# EasyEDA Pro project kuafu01_030内部老化方案.eprj, board PCB4
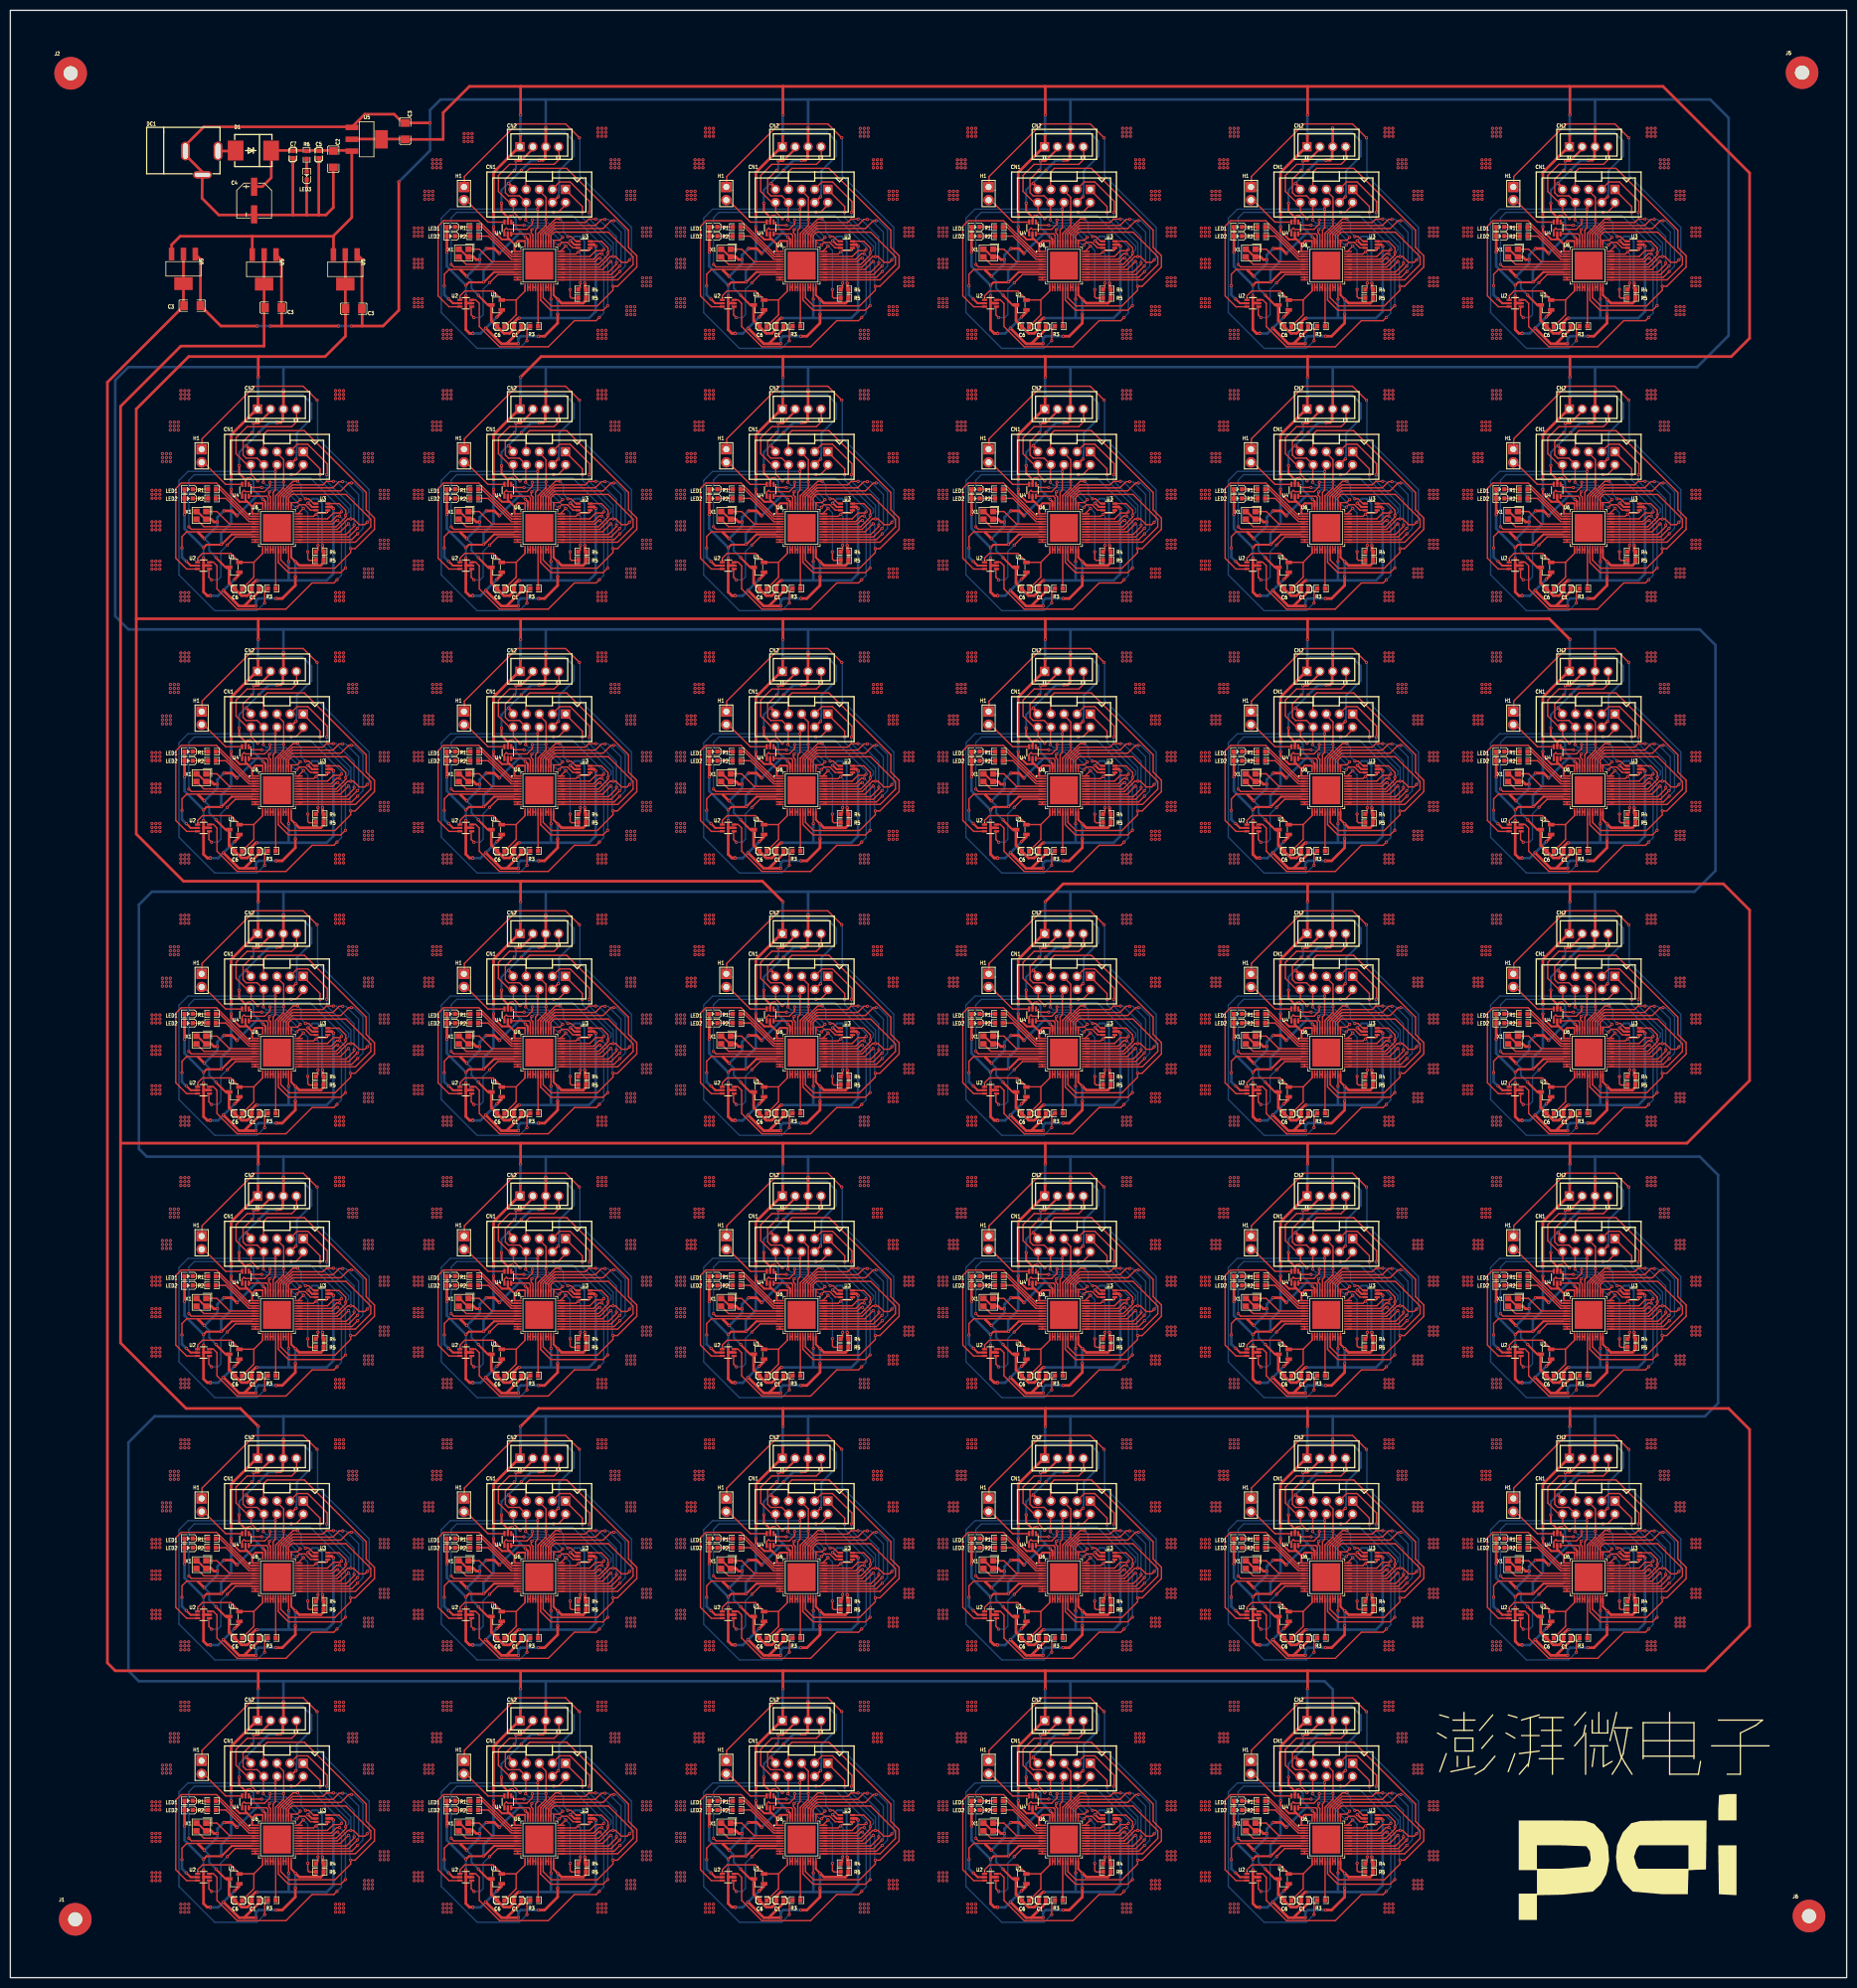
[diagram p2: board, top side]
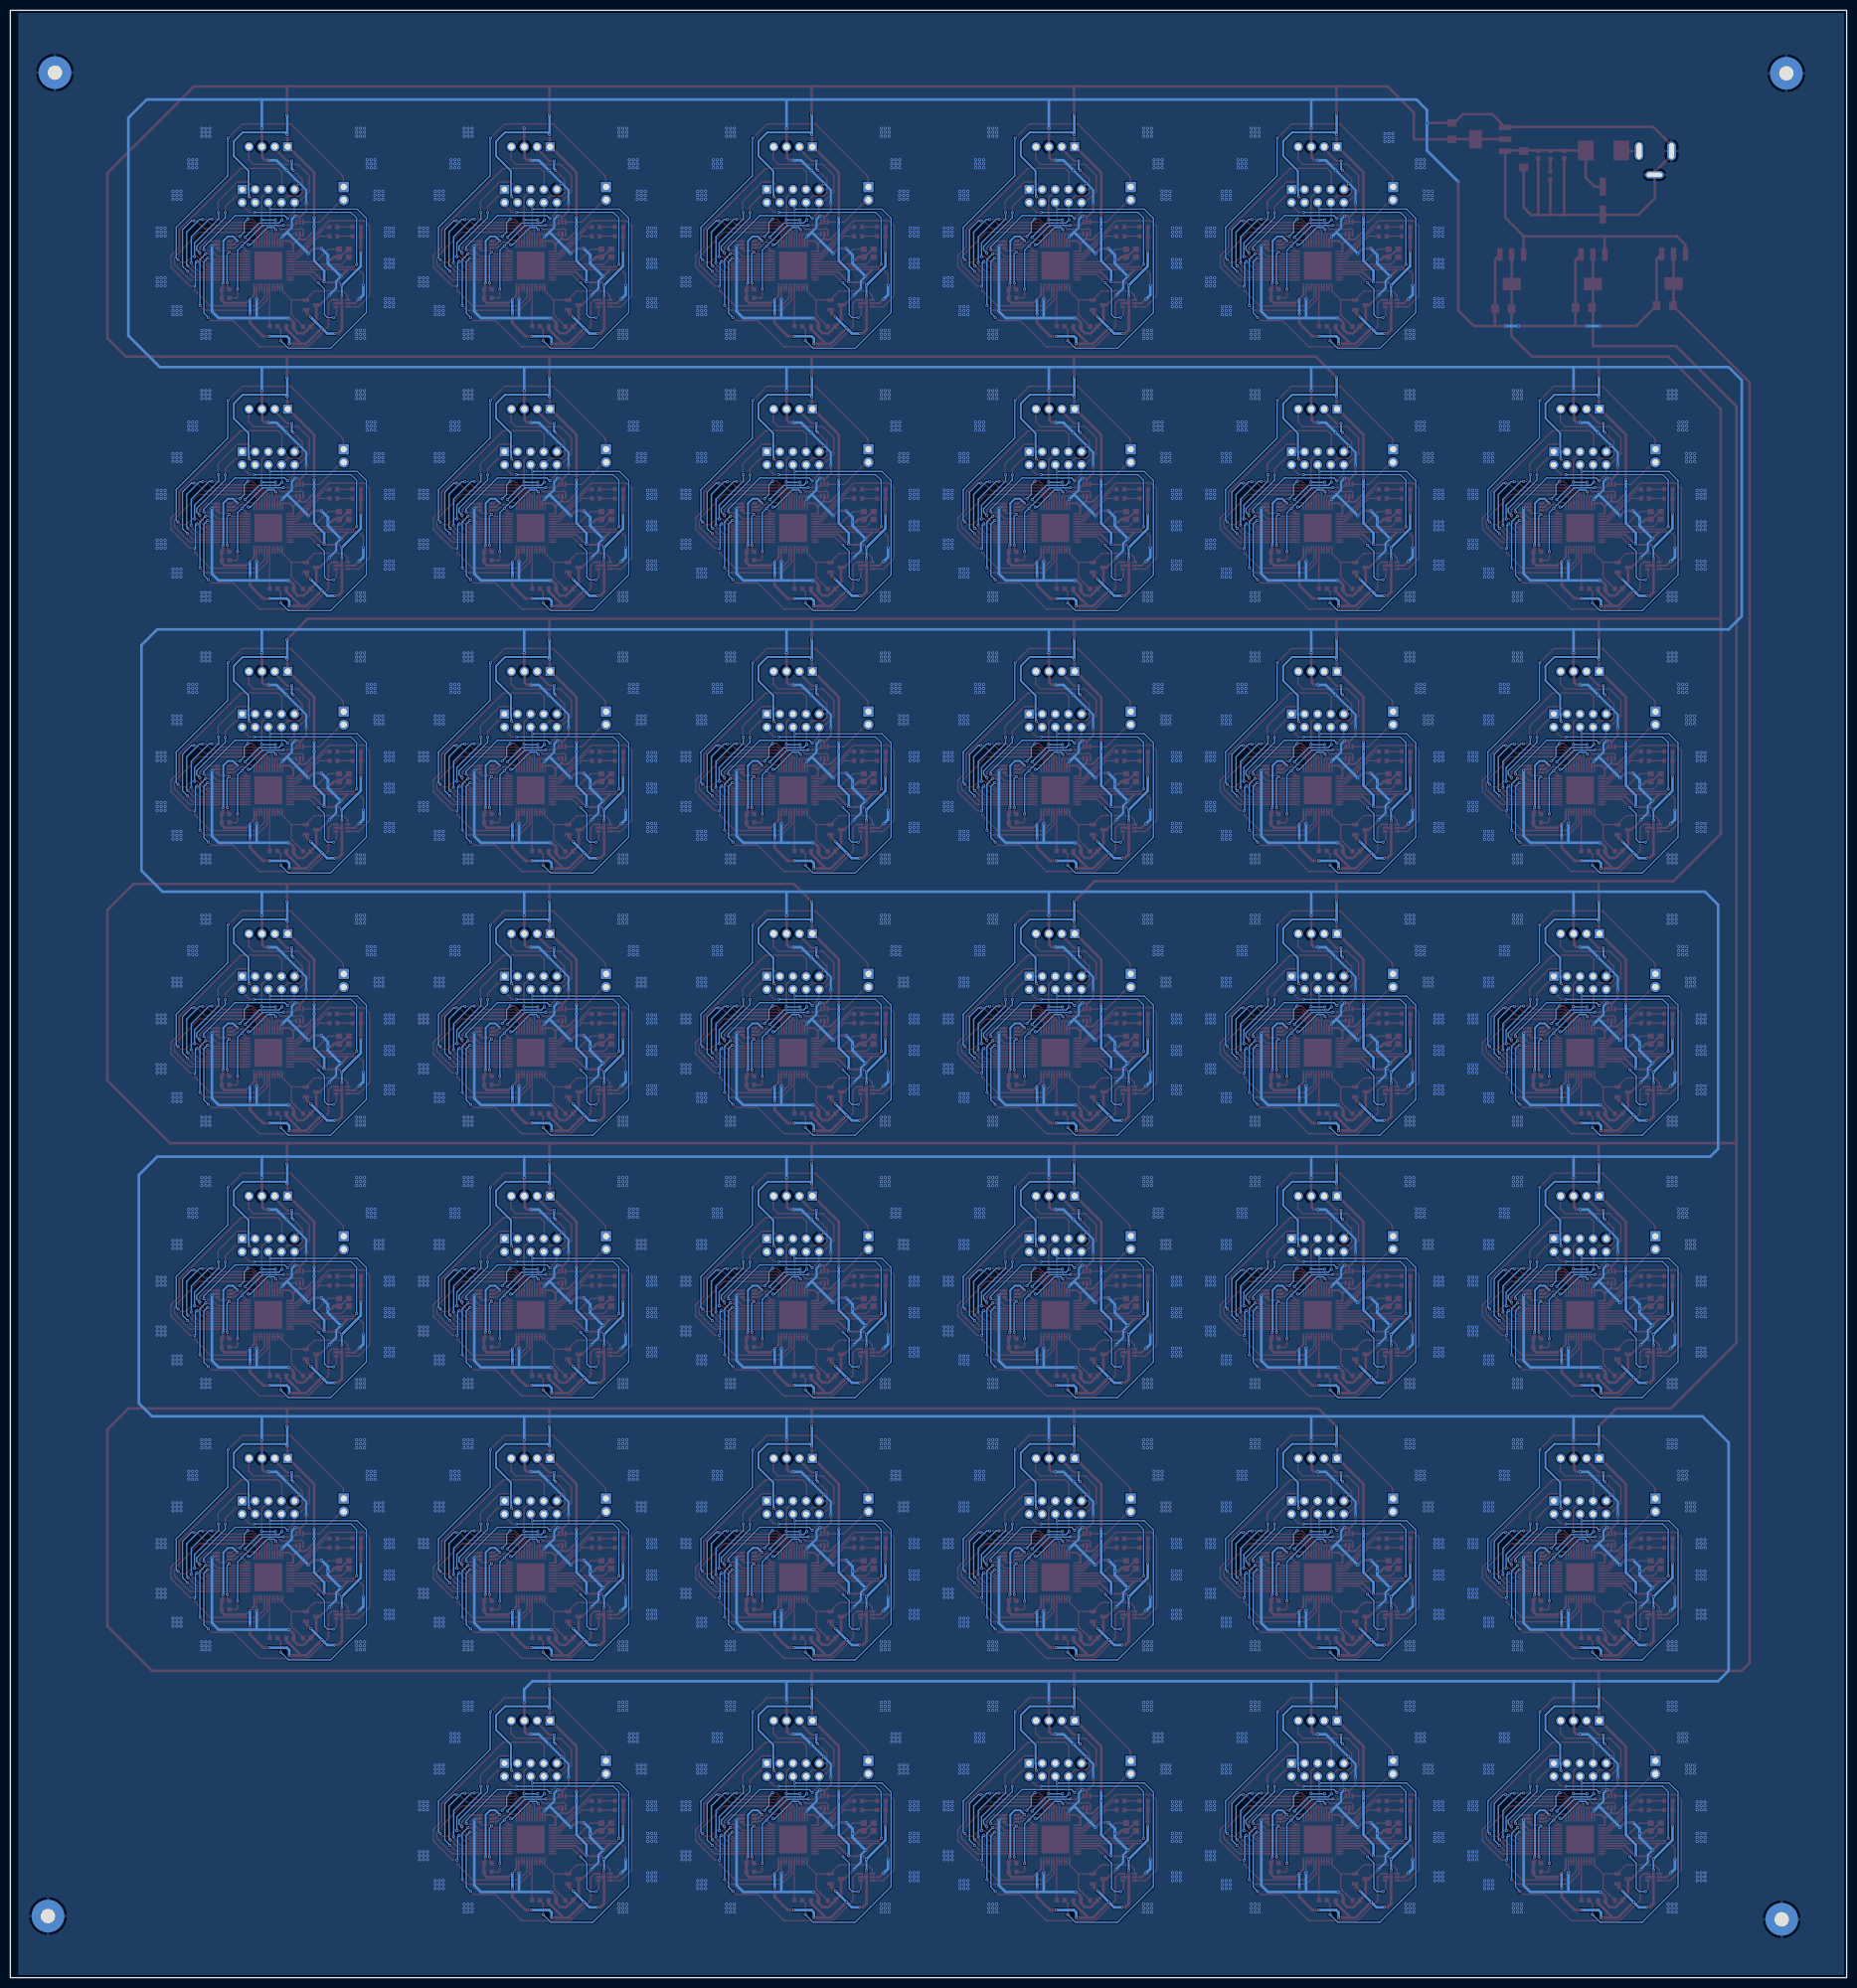
[diagram p3: board, bottom side, seen from below]

Outline 355.6 x 381 mm; copper layers: Top Layer, Bottom Layer. Coordinates in mm from the lower left corner of the outline.
Outline path: rectangle 0,381 355.6,0
Stack: Top Layer 0.035mm / Dielectric1 1.51mm FR4 er 4.5 / Bottom Layer 0.035mm

## Design rules (mm)
spacing safeClearance (default): track to track 0.152, other pairs 0.152 to 0.3
track width trackWidth (default): min 0.127, default 0.254, max 2.54
differential pair differentialPair (default): width min 0.127, default 0.254, max 2.54; gap min 0.152, default 0.152
via viaSize (default): diameter min 0.5, default 0.61, max 10; hole min 0.3, default 0.305, max 6

## Placement (name value [footprint] x y rotation side)
C1  470nF  [C0603]  301.44 268.96 180 top
C1#2  -  [C0603]  47.44 218.16 180 top
C1#3  -  [C0603]  98.24 218.16 180 top
C1#4  -  [C0603]  149.04 218.16 180 top
C1#5  -  [C0603]  199.84 218.16 180 top
C1#6  -  [C0603]  250.64 218.16 180 top
C1#7  -  [C0603]  301.44 218.16 180 top
C1#8  -  [C0603]  47.44 167.37 180 top
C1#9  -  [C0603]  98.24 167.37 180 top
C1#10  -  [C0603]  149.04 167.37 180 top
C1#11  -  [C0603]  199.84 167.37 180 top
C1#12  -  [C0603]  250.64 167.37 180 top
C1#13  -  [C0603]  301.44 167.37 180 top
C1#14  -  [C0603]  47.44 116.56 180 top
C1#15  -  [C0603]  98.24 116.56 180 top
C1#16  -  [C0603]  149.04 116.56 180 top
C1#17  -  [C0603]  199.84 116.56 180 top
C1#18  -  [C0603]  250.64 116.56 180 top
C1#19  -  [C0603]  301.44 116.56 180 top
C1#20  -  [C0603]  47.44 65.76 180 top
C1#21  -  [C0603]  98.24 65.76 180 top
C1#22  -  [C0603]  149.04 65.76 180 top
C1#23  -  [C0603]  199.84 65.76 180 top
C1#24  -  [C0603]  250.64 65.76 180 top
C1#25  -  [C0603]  301.44 65.76 180 top
C1#26  -  [C0603]  47.44 14.96 180 top
C1#27  -  [C0603]  98.24 14.96 180 top
C1#28  -  [C0603]  149.04 14.96 180 top
C1#29  -  [C0603]  199.84 14.96 180 top
C1#30  -  [C0603]  250.64 14.96 180 top
C1#31  -  [C0603]  98.24 319.76 180 top
C1#32  -  [C0603]  149.04 319.76 180 top
C1#33  -  [C0603]  199.84 319.76 180 top
C1#34  -  [C0603]  250.64 319.76 180 top
C1#35  -  [C0603]  301.44 319.76 180 top
C1#36  -  [C0603]  47.44 268.96 180 top
C1#37  -  [C0603]  98.24 268.96 180 top
C1#38  -  [C0603]  149.04 268.96 180 top
C1#39  -  [C0603]  199.84 268.96 180 top
C1#40  -  [C0603]  250.64 268.96 180 top
C2  10uF  [C1206]  62.54 352.17 270 top
C3  10uF  [C1206]  35.23 323.81 180 top
C3#2  -  [C1206]  50.91 323.42 180 top
C3#3  -  [C1206]  76.47 357.6 270 top
C3#4  -  [C1206]  66.49 323.21 180 top
C4  100uF  [CAP-SMD_BD6.3-L6.6-W6.6-LS7.6-FD-1]  47.21 344.16 270 top
C5  100nF  [C0603]  59.73 353.07 90 top
C6  100nF  [C0603]  298.19 268.95 0 top
C6#2  -  [C0603]  44.19 218.15 0 top
C6#3  -  [C0603]  94.99 218.15 0 top
C6#4  -  [C0603]  145.79 218.15 0 top
C6#5  -  [C0603]  196.59 218.15 0 top
C6#6  -  [C0603]  247.39 218.15 0 top
C6#7  -  [C0603]  298.19 218.15 0 top
C6#8  -  [C0603]  44.19 167.35 0 top
C6#9  -  [C0603]  94.99 167.35 0 top
C6#10  -  [C0603]  145.79 167.35 0 top
C6#11  -  [C0603]  196.59 167.35 0 top
C6#12  -  [C0603]  247.39 167.35 0 top
C6#13  -  [C0603]  298.19 167.35 0 top
C6#14  -  [C0603]  44.19 116.55 0 top
C6#15  -  [C0603]  94.99 116.55 0 top
C6#16  -  [C0603]  145.79 116.55 0 top
C6#17  -  [C0603]  196.59 116.55 0 top
C6#18  -  [C0603]  247.39 116.55 0 top
C6#19  -  [C0603]  298.19 116.55 0 top
C6#20  -  [C0603]  44.19 65.75 0 top
C6#21  -  [C0603]  94.99 65.75 0 top
C6#22  -  [C0603]  145.79 65.75 0 top
C6#23  -  [C0603]  196.59 65.75 0 top
C6#24  -  [C0603]  247.39 65.75 0 top
C6#25  -  [C0603]  298.19 65.75 0 top
C6#26  -  [C0603]  44.19 14.95 0 top
C6#27  -  [C0603]  94.99 14.95 0 top
C6#28  -  [C0603]  145.79 14.95 0 top
C6#29  -  [C0603]  196.59 14.95 0 top
C6#30  -  [C0603]  247.39 14.95 0 top
C6#31  -  [C0603]  94.99 319.75 0 top
C6#32  -  [C0603]  145.79 319.75 0 top
C6#33  -  [C0603]  196.59 319.75 0 top
C6#34  -  [C0603]  247.39 319.75 0 top
C6#35  -  [C0603]  298.19 319.75 0 top
C6#36  -  [C0603]  44.19 268.95 0 top
C6#37  -  [C0603]  94.99 268.95 0 top
C6#38  -  [C0603]  145.79 268.95 0 top
C6#39  -  [C0603]  196.59 268.95 0 top
C6#40  -  [C0603]  247.39 268.95 0 top
C7  100nF  [C0603]  54.7 353.09 90 top
CN1  DS254P-2X5-L0  [IDC-TH_10P-P2.54-V-R2-C5-S2.54]  305.64 294.25 180 top
CN1#2  -  [IDC-TH_10P-P2.54-V-R2-C5-S2.54]  51.64 243.45 180 top
CN1#3  -  [IDC-TH_10P-P2.54-V-R2-C5-S2.54]  102.44 243.45 180 top
CN1#4  -  [IDC-TH_10P-P2.54-V-R2-C5-S2.54]  153.24 243.45 180 top
CN1#5  -  [IDC-TH_10P-P2.54-V-R2-C5-S2.54]  204.04 243.45 180 top
CN1#6  -  [IDC-TH_10P-P2.54-V-R2-C5-S2.54]  254.84 243.45 180 top
CN1#7  -  [IDC-TH_10P-P2.54-V-R2-C5-S2.54]  305.64 243.45 180 top
CN1#8  -  [IDC-TH_10P-P2.54-V-R2-C5-S2.54]  51.64 192.65 180 top
CN1#9  -  [IDC-TH_10P-P2.54-V-R2-C5-S2.54]  102.44 192.65 180 top
CN1#10  -  [IDC-TH_10P-P2.54-V-R2-C5-S2.54]  153.24 192.65 180 top
CN1#11  -  [IDC-TH_10P-P2.54-V-R2-C5-S2.54]  204.04 192.65 180 top
CN1#12  -  [IDC-TH_10P-P2.54-V-R2-C5-S2.54]  254.84 192.65 180 top
CN1#13  -  [IDC-TH_10P-P2.54-V-R2-C5-S2.54]  305.64 192.65 180 top
CN1#14  -  [IDC-TH_10P-P2.54-V-R2-C5-S2.54]  51.64 141.85 180 top
CN1#15  -  [IDC-TH_10P-P2.54-V-R2-C5-S2.54]  102.44 141.85 180 top
CN1#16  -  [IDC-TH_10P-P2.54-V-R2-C5-S2.54]  153.24 141.85 180 top
CN1#17  -  [IDC-TH_10P-P2.54-V-R2-C5-S2.54]  204.04 141.85 180 top
CN1#18  -  [IDC-TH_10P-P2.54-V-R2-C5-S2.54]  254.84 141.85 180 top
CN1#19  -  [IDC-TH_10P-P2.54-V-R2-C5-S2.54]  305.64 141.85 180 top
CN1#20  -  [IDC-TH_10P-P2.54-V-R2-C5-S2.54]  51.64 91.05 180 top
CN1#21  -  [IDC-TH_10P-P2.54-V-R2-C5-S2.54]  102.44 91.05 180 top
CN1#22  -  [IDC-TH_10P-P2.54-V-R2-C5-S2.54]  153.24 91.05 180 top
CN1#23  -  [IDC-TH_10P-P2.54-V-R2-C5-S2.54]  204.04 91.05 180 top
CN1#24  -  [IDC-TH_10P-P2.54-V-R2-C5-S2.54]  254.84 91.05 180 top
CN1#25  -  [IDC-TH_10P-P2.54-V-R2-C5-S2.54]  305.64 91.05 180 top
CN1#26  -  [IDC-TH_10P-P2.54-V-R2-C5-S2.54]  51.64 40.25 180 top
CN1#27  -  [IDC-TH_10P-P2.54-V-R2-C5-S2.54]  102.44 40.25 180 top
CN1#28  -  [IDC-TH_10P-P2.54-V-R2-C5-S2.54]  153.24 40.25 180 top
CN1#29  -  [IDC-TH_10P-P2.54-V-R2-C5-S2.54]  204.04 40.25 180 top
CN1#30  -  [IDC-TH_10P-P2.54-V-R2-C5-S2.54]  254.84 40.25 180 top
CN1#31  -  [IDC-TH_10P-P2.54-V-R2-C5-S2.54]  102.44 345.05 180 top
CN1#32  -  [IDC-TH_10P-P2.54-V-R2-C5-S2.54]  153.24 345.05 180 top
CN1#33  -  [IDC-TH_10P-P2.54-V-R2-C5-S2.54]  204.04 345.05 180 top
CN1#34  -  [IDC-TH_10P-P2.54-V-R2-C5-S2.54]  254.84 345.05 180 top
CN1#35  -  [IDC-TH_10P-P2.54-V-R2-C5-S2.54]  305.64 345.05 180 top
CN1#36  -  [IDC-TH_10P-P2.54-V-R2-C5-S2.54]  51.64 294.25 180 top
CN1#37  -  [IDC-TH_10P-P2.54-V-R2-C5-S2.54]  102.44 294.25 180 top
CN1#38  -  [IDC-TH_10P-P2.54-V-R2-C5-S2.54]  153.24 294.25 180 top
CN1#39  -  [IDC-TH_10P-P2.54-V-R2-C5-S2.54]  204.04 294.25 180 top
CN1#40  -  [IDC-TH_10P-P2.54-V-R2-C5-S2.54]  254.84 294.25 180 top
CN2  XH-4A  [CONN-TH_4P-P2.50_XH-4A]  305.63 303.77 0 top
CN2#2  -  [CONN-TH_4P-P2.50_XH-4A]  51.63 252.97 0 top
CN2#3  -  [CONN-TH_4P-P2.50_XH-4A]  102.43 252.97 0 top
CN2#4  -  [CONN-TH_4P-P2.50_XH-4A]  153.23 252.97 0 top
CN2#5  -  [CONN-TH_4P-P2.50_XH-4A]  204.03 252.97 0 top
CN2#6  -  [CONN-TH_4P-P2.50_XH-4A]  254.83 252.97 0 top
CN2#7  -  [CONN-TH_4P-P2.50_XH-4A]  305.63 252.97 0 top
CN2#8  -  [CONN-TH_4P-P2.50_XH-4A]  51.63 202.17 0 top
CN2#9  -  [CONN-TH_4P-P2.50_XH-4A]  102.43 202.17 0 top
CN2#10  -  [CONN-TH_4P-P2.50_XH-4A]  153.23 202.17 0 top
CN2#11  -  [CONN-TH_4P-P2.50_XH-4A]  204.03 202.17 0 top
CN2#12  -  [CONN-TH_4P-P2.50_XH-4A]  254.83 202.17 0 top
CN2#13  -  [CONN-TH_4P-P2.50_XH-4A]  305.63 202.17 0 top
CN2#14  -  [CONN-TH_4P-P2.50_XH-4A]  51.63 151.37 0 top
CN2#15  -  [CONN-TH_4P-P2.50_XH-4A]  102.43 151.37 0 top
CN2#16  -  [CONN-TH_4P-P2.50_XH-4A]  153.23 151.37 0 top
CN2#17  -  [CONN-TH_4P-P2.50_XH-4A]  204.03 151.37 0 top
CN2#18  -  [CONN-TH_4P-P2.50_XH-4A]  254.83 151.37 0 top
CN2#19  -  [CONN-TH_4P-P2.50_XH-4A]  305.63 151.37 0 top
CN2#20  -  [CONN-TH_4P-P2.50_XH-4A]  51.63 100.57 0 top
CN2#21  -  [CONN-TH_4P-P2.50_XH-4A]  102.43 100.57 0 top
CN2#22  -  [CONN-TH_4P-P2.50_XH-4A]  153.23 100.57 0 top
CN2#23  -  [CONN-TH_4P-P2.50_XH-4A]  204.03 100.57 0 top
CN2#24  -  [CONN-TH_4P-P2.50_XH-4A]  254.83 100.57 0 top
CN2#25  -  [CONN-TH_4P-P2.50_XH-4A]  305.63 100.57 0 top
CN2#26  -  [CONN-TH_4P-P2.50_XH-4A]  51.63 49.77 0 top
CN2#27  -  [CONN-TH_4P-P2.50_XH-4A]  102.43 49.77 0 top
CN2#28  -  [CONN-TH_4P-P2.50_XH-4A]  153.23 49.77 0 top
CN2#29  -  [CONN-TH_4P-P2.50_XH-4A]  204.03 49.77 0 top
CN2#30  -  [CONN-TH_4P-P2.50_XH-4A]  254.83 49.77 0 top
CN2#31  -  [CONN-TH_4P-P2.50_XH-4A]  102.43 354.57 0 top
CN2#32  -  [CONN-TH_4P-P2.50_XH-4A]  153.23 354.57 0 top
CN2#33  -  [CONN-TH_4P-P2.50_XH-4A]  204.03 354.57 0 top
CN2#34  -  [CONN-TH_4P-P2.50_XH-4A]  254.83 354.57 0 top
CN2#35  -  [CONN-TH_4P-P2.50_XH-4A]  305.63 354.57 0 top
CN2#36  -  [CONN-TH_4P-P2.50_XH-4A]  51.63 303.77 0 top
CN2#37  -  [CONN-TH_4P-P2.50_XH-4A]  102.43 303.77 0 top
CN2#38  -  [CONN-TH_4P-P2.50_XH-4A]  153.23 303.77 0 top
CN2#39  -  [CONN-TH_4P-P2.50_XH-4A]  204.03 303.77 0 top
CN2#40  -  [CONN-TH_4P-P2.50_XH-4A]  254.83 303.77 0 top
D1  SS36-E3/57T  [SMC_L7.1-W6.2-LS8.1-R-RD]  47.06 353.84 180 top
DC1  HX DC005 QT  [DC-IN-TH_HANXIA_HX-DC005-QT]  37.05 351.45 0 top
H1  PZ254V-11-02P  [HDR-TH_2P-P2.54-V-M]  291.04 294.73 270 top
H1#2  -  [HDR-TH_2P-P2.54-V-M]  37.04 243.93 270 top
H1#3  -  [HDR-TH_2P-P2.54-V-M]  87.84 243.93 270 top
H1#4  -  [HDR-TH_2P-P2.54-V-M]  138.64 243.93 270 top
H1#5  -  [HDR-TH_2P-P2.54-V-M]  189.44 243.93 270 top
H1#6  -  [HDR-TH_2P-P2.54-V-M]  240.24 243.93 270 top
H1#7  -  [HDR-TH_2P-P2.54-V-M]  291.04 243.93 270 top
H1#8  -  [HDR-TH_2P-P2.54-V-M]  37.04 193.13 270 top
H1#9  -  [HDR-TH_2P-P2.54-V-M]  87.84 193.13 270 top
H1#10  -  [HDR-TH_2P-P2.54-V-M]  138.64 193.13 270 top
H1#11  -  [HDR-TH_2P-P2.54-V-M]  189.44 193.13 270 top
H1#12  -  [HDR-TH_2P-P2.54-V-M]  240.24 193.13 270 top
H1#13  -  [HDR-TH_2P-P2.54-V-M]  291.04 193.13 270 top
H1#14  -  [HDR-TH_2P-P2.54-V-M]  37.04 142.33 270 top
H1#15  -  [HDR-TH_2P-P2.54-V-M]  87.84 142.33 270 top
H1#16  -  [HDR-TH_2P-P2.54-V-M]  138.64 142.33 270 top
H1#17  -  [HDR-TH_2P-P2.54-V-M]  189.44 142.33 270 top
H1#18  -  [HDR-TH_2P-P2.54-V-M]  240.24 142.33 270 top
H1#19  -  [HDR-TH_2P-P2.54-V-M]  291.04 142.33 270 top
H1#20  -  [HDR-TH_2P-P2.54-V-M]  37.04 91.53 270 top
H1#21  -  [HDR-TH_2P-P2.54-V-M]  87.84 91.53 270 top
H1#22  -  [HDR-TH_2P-P2.54-V-M]  138.64 91.53 270 top
H1#23  -  [HDR-TH_2P-P2.54-V-M]  189.44 91.53 270 top
H1#24  -  [HDR-TH_2P-P2.54-V-M]  240.24 91.53 270 top
H1#25  -  [HDR-TH_2P-P2.54-V-M]  291.04 91.53 270 top
H1#26  -  [HDR-TH_2P-P2.54-V-M]  37.04 40.73 270 top
H1#27  -  [HDR-TH_2P-P2.54-V-M]  87.84 40.73 270 top
H1#28  -  [HDR-TH_2P-P2.54-V-M]  138.64 40.73 270 top
H1#29  -  [HDR-TH_2P-P2.54-V-M]  189.44 40.73 270 top
H1#30  -  [HDR-TH_2P-P2.54-V-M]  240.24 40.73 270 top
H1#31  -  [HDR-TH_2P-P2.54-V-M]  87.84 345.53 270 top
H1#32  -  [HDR-TH_2P-P2.54-V-M]  138.64 345.53 270 top
H1#33  -  [HDR-TH_2P-P2.54-V-M]  189.44 345.53 270 top
H1#34  -  [HDR-TH_2P-P2.54-V-M]  240.24 345.53 270 top
H1#35  -  [HDR-TH_2P-P2.54-V-M]  291.04 345.53 270 top
H1#36  -  [HDR-TH_2P-P2.54-V-M]  37.04 294.73 270 top
H1#37  -  [HDR-TH_2P-P2.54-V-M]  87.84 294.73 270 top
H1#38  -  [HDR-TH_2P-P2.54-V-M]  138.64 294.73 270 top
H1#39  -  [HDR-TH_2P-P2.54-V-M]  189.44 294.73 270 top
H1#40  -  [HDR-TH_2P-P2.54-V-M]  240.24 294.73 270 top
J1  -  [DEMO板安装孔]  12.57 11.3 0 top
J2  -  [DEMO板安装孔]  11.68 368.81 0 top
J5  -  [DEMO板安装孔]  346.96 368.94 0 top
J6  -  [DEMO板安装孔]  348.31 11.93 0 top
LED1  NCD0603R1  [LED0603-RD_RED]  237.7 288.25 180 top
LED1#2  -  [LED0603-RD_RED]  288.5 288.25 180 top
LED1#3  -  [LED0603-RD_RED]  34.5 237.45 180 top
LED1#4  -  [LED0603-RD_RED]  85.3 237.45 180 top
LED1#5  -  [LED0603-RD_RED]  136.1 237.45 180 top
LED1#6  -  [LED0603-RD_RED]  186.9 237.45 180 top
LED1#7  -  [LED0603-RD_RED]  237.7 237.45 180 top
LED1#8  -  [LED0603-RD_RED]  288.5 237.45 180 top
LED1#9  -  [LED0603-RD_RED]  34.5 186.65 180 top
LED1#10  -  [LED0603-RD_RED]  85.3 186.65 180 top
LED1#11  -  [LED0603-RD_RED]  136.1 186.65 180 top
LED1#12  -  [LED0603-RD_RED]  186.9 186.65 180 top
LED1#13  -  [LED0603-RD_RED]  237.7 186.65 180 top
LED1#14  -  [LED0603-RD_RED]  288.5 186.65 180 top
LED1#15  -  [LED0603-RD_RED]  34.5 135.85 180 top
LED1#16  -  [LED0603-RD_RED]  85.3 135.85 180 top
LED1#17  -  [LED0603-RD_RED]  136.1 135.85 180 top
LED1#18  -  [LED0603-RD_RED]  186.9 135.85 180 top
LED1#19  -  [LED0603-RD_RED]  237.7 135.85 180 top
LED1#20  -  [LED0603-RD_RED]  288.5 135.85 180 top
LED1#21  -  [LED0603-RD_RED]  34.5 85.05 180 top
LED1#22  -  [LED0603-RD_RED]  85.3 85.05 180 top
LED1#23  -  [LED0603-RD_RED]  136.1 85.05 180 top
LED1#24  -  [LED0603-RD_RED]  186.9 85.05 180 top
LED1#25  -  [LED0603-RD_RED]  237.7 85.05 180 top
LED1#26  -  [LED0603-RD_RED]  288.5 85.05 180 top
LED1#27  -  [LED0603-RD_RED]  34.5 34.25 180 top
LED1#28  -  [LED0603-RD_RED]  85.3 34.25 180 top
LED1#29  -  [LED0603-RD_RED]  136.1 34.25 180 top
LED1#30  -  [LED0603-RD_RED]  186.9 34.25 180 top
LED1#31  -  [LED0603-RD_RED]  237.7 34.25 180 top
LED1#32  -  [LED0603-RD_RED]  85.3 339.05 180 top
LED1#33  -  [LED0603-RD_RED]  136.1 339.05 180 top
LED1#34  -  [LED0603-RD_RED]  186.9 339.05 180 top
LED1#35  -  [LED0603-RD_RED]  237.7 339.05 180 top
LED1#36  -  [LED0603-RD_RED]  288.5 339.05 180 top
LED1#37  -  [LED0603-RD_RED]  34.5 288.25 180 top
LED1#38  -  [LED0603-RD_RED]  85.3 288.25 180 top
LED1#39  -  [LED0603-RD_RED]  136.1 288.25 180 top
LED1#40  -  [LED0603-RD_RED]  186.9 288.25 180 top
LED2  19-217/GHC-YR1S2/3T  [LED0603-RD]  237.71 286.46 180 top
LED2#2  -  [LED0603-RD]  288.51 286.46 180 top
LED2#3  -  [LED0603-RD]  34.51 235.66 180 top
LED2#4  -  [LED0603-RD]  85.31 235.66 180 top
LED2#5  -  [LED0603-RD]  136.11 235.66 180 top
LED2#6  -  [LED0603-RD]  186.91 235.66 180 top
LED2#7  -  [LED0603-RD]  237.71 235.66 180 top
LED2#8  -  [LED0603-RD]  288.51 235.66 180 top
LED2#9  -  [LED0603-RD]  34.51 184.86 180 top
LED2#10  -  [LED0603-RD]  85.31 184.86 180 top
LED2#11  -  [LED0603-RD]  136.11 184.86 180 top
LED2#12  -  [LED0603-RD]  186.91 184.86 180 top
LED2#13  -  [LED0603-RD]  237.71 184.86 180 top
LED2#14  -  [LED0603-RD]  288.51 184.86 180 top
LED2#15  -  [LED0603-RD]  34.51 134.06 180 top
LED2#16  -  [LED0603-RD]  85.31 134.06 180 top
LED2#17  -  [LED0603-RD]  136.11 134.06 180 top
LED2#18  -  [LED0603-RD]  186.91 134.06 180 top
LED2#19  -  [LED0603-RD]  237.71 134.06 180 top
LED2#20  -  [LED0603-RD]  288.51 134.06 180 top
LED2#21  -  [LED0603-RD]  34.51 83.26 180 top
LED2#22  -  [LED0603-RD]  85.31 83.26 180 top
LED2#23  -  [LED0603-RD]  136.11 83.26 180 top
LED2#24  -  [LED0603-RD]  186.91 83.26 180 top
LED2#25  -  [LED0603-RD]  237.71 83.26 180 top
LED2#26  -  [LED0603-RD]  288.51 83.26 180 top
LED2#27  -  [LED0603-RD]  34.51 32.46 180 top
LED2#28  -  [LED0603-RD]  85.31 32.46 180 top
LED2#29  -  [LED0603-RD]  136.11 32.46 180 top
LED2#30  -  [LED0603-RD]  186.91 32.46 180 top
LED2#31  -  [LED0603-RD]  237.71 32.46 180 top
LED2#32  -  [LED0603-RD]  85.31 337.26 180 top
LED2#33  -  [LED0603-RD]  136.11 337.26 180 top
LED2#34  -  [LED0603-RD]  186.91 337.26 180 top
LED2#35  -  [LED0603-RD]  237.71 337.26 180 top
LED2#36  -  [LED0603-RD]  288.51 337.26 180 top
LED2#37  -  [LED0603-RD]  34.51 286.46 180 top
LED2#38  -  [LED0603-RD]  85.31 286.46 180 top
LED2#39  -  [LED0603-RD]  136.11 286.46 180 top
LED2#40  -  [LED0603-RD]  186.91 286.46 180 top
LED3  19-217/GHC-YR1S2/3T  [LED0603-RD]  57.4 349 90 top
R1  10K  [R0603]  242.25 288.23 180 top
R1#2  -  [R0603]  293.05 288.23 180 top
R1#3  -  [R0603]  39.05 237.43 180 top
R1#4  -  [R0603]  89.85 237.43 180 top
R1#5  -  [R0603]  140.65 237.43 180 top
R1#6  -  [R0603]  191.45 237.43 180 top
R1#7  -  [R0603]  242.25 237.43 180 top
R1#8  -  [R0603]  293.05 237.43 180 top
R1#9  -  [R0603]  39.05 186.63 180 top
R1#10  -  [R0603]  89.85 186.63 180 top
R1#11  -  [R0603]  140.65 186.63 180 top
R1#12  -  [R0603]  191.45 186.63 180 top
R1#13  -  [R0603]  242.25 186.63 180 top
R1#14  -  [R0603]  293.05 186.63 180 top
R1#15  -  [R0603]  39.05 135.83 180 top
R1#16  -  [R0603]  89.85 135.83 180 top
R1#17  -  [R0603]  140.65 135.83 180 top
R1#18  -  [R0603]  191.45 135.83 180 top
R1#19  -  [R0603]  242.25 135.83 180 top
R1#20  -  [R0603]  293.05 135.83 180 top
R1#21  -  [R0603]  39.05 85.03 180 top
R1#22  -  [R0603]  89.85 85.03 180 top
R1#23  -  [R0603]  140.65 85.03 180 top
R1#24  -  [R0603]  191.45 85.03 180 top
R1#25  -  [R0603]  242.25 85.03 180 top
R1#26  -  [R0603]  293.05 85.03 180 top
R1#27  -  [R0603]  39.05 34.23 180 top
R1#28  -  [R0603]  89.85 34.23 180 top
R1#29  -  [R0603]  140.65 34.23 180 top
R1#30  -  [R0603]  191.45 34.23 180 top
R1#31  -  [R0603]  242.25 34.23 180 top
R1#32  -  [R0603]  89.85 339.03 180 top
R1#33  -  [R0603]  140.65 339.03 180 top
R1#34  -  [R0603]  191.45 339.03 180 top
R1#35  -  [R0603]  242.25 339.03 180 top
R1#36  -  [R0603]  293.05 339.03 180 top
R1#37  -  [R0603]  39.05 288.23 180 top
R1#38  -  [R0603]  89.85 288.23 180 top
R1#39  -  [R0603]  140.65 288.23 180 top
R1#40  -  [R0603]  191.45 288.23 180 top
R2  10K  [R0603]  242.24 286.47 180 top
R2#2  -  [R0603]  293.04 286.47 180 top
R2#3  -  [R0603]  39.04 235.67 180 top
R2#4  -  [R0603]  89.84 235.67 180 top
R2#5  -  [R0603]  140.64 235.67 180 top
R2#6  -  [R0603]  191.44 235.67 180 top
R2#7  -  [R0603]  242.24 235.67 180 top
R2#8  -  [R0603]  293.04 235.67 180 top
R2#9  -  [R0603]  39.04 184.87 180 top
R2#10  -  [R0603]  89.84 184.87 180 top
R2#11  -  [R0603]  140.64 184.87 180 top
R2#12  -  [R0603]  191.44 184.87 180 top
R2#13  -  [R0603]  242.24 184.87 180 top
R2#14  -  [R0603]  293.04 184.87 180 top